# EasyEDA Pro project ProProject_Avaota Pi A_2024-03-25.epro, board 点位 (continued)
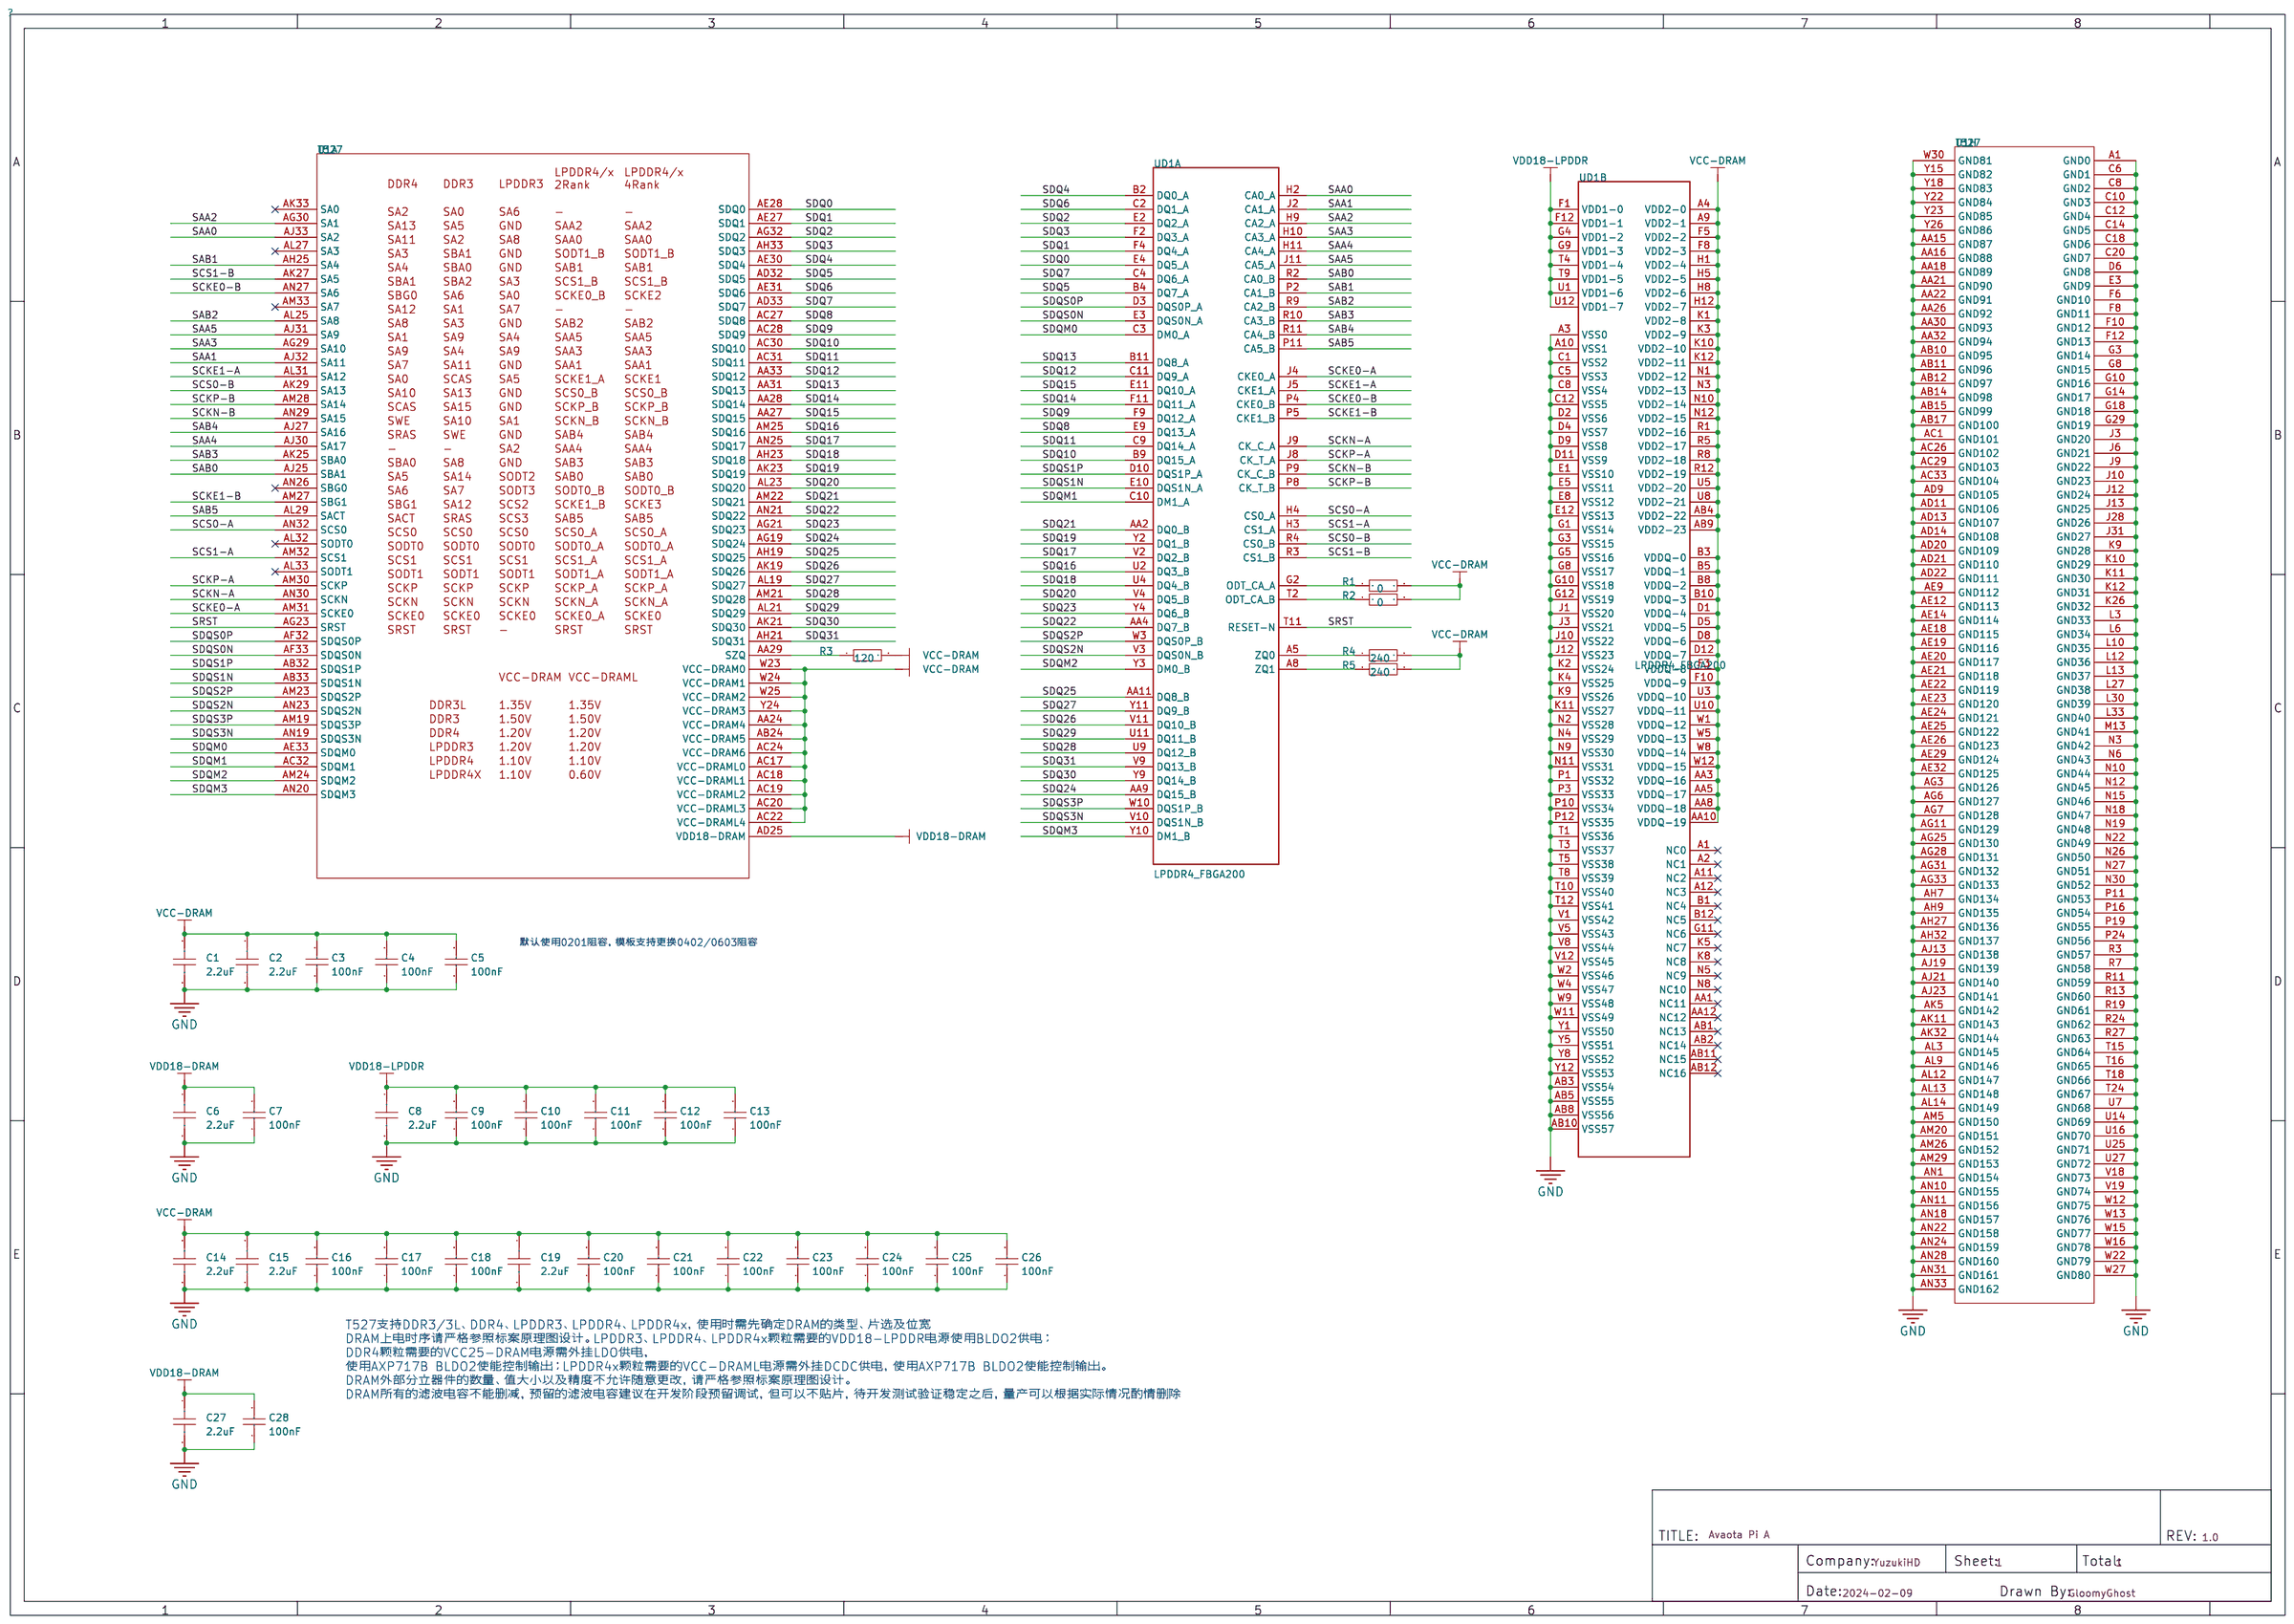
[diagram p0: schematic sheet]
## Routing (per net, layer and track width the routed paths; a pad name or vN(x,y) marks a point on that pad's centre or on a via; arc(x,y) is an arc through that point) (continued)
  Top Layer w0.115: 53.43,45.64 53.38,45.59 ; 53.38,45.59 53.39,45.59 U14.AN22 ; 53.38,45.59 52.63,45.59 52.07,45.03 51.2,45.03 50.8,45.44 v2(50.8,45.47)
  Top Layer w0.127: U14.C31 U14.C30 ; v2(35.38,50.42) 35.41,50.38 36.18,50.38 v2(36.23,50.43) ; D15.8 D15.3 ; C266.2 v3(67.61,17.7) ; 53.01,43.39 53,43.38 52.24,43.38 v2(52.09,43.23) ; D10.8 D10.3 ; v1(34.44,36.65) 35.23,35.87 35.23,34.21 35.81,33.63 ; D8.3 D8.8 ; v2(40.21,49.61) 40.11,49.71 39.35,49.71 ; v2(49.6,46.65) 49.06,46.65 48.94,46.53 48.49,46.53 48.16,46.86 48.16,47.62 48.33,47.8 v2(48.36,47.8) ; 41.41,46.15 41.71,46.46 43.13,46.46 44.88,44.7 44.88,44.48 48.46,40.89 52.74,40.89 ; v2(34.59,49.71) 34.58,49.72 33.92,49.72 ; 64.85,57.33 v3(64.99,57.47) ; 51.22,24.8 R60.1 51.37,24.56 v3(51.46,24.56) ; U8.N5 U8.P6 36.06,33.39 35.81,33.63 ; 35.81,33.63 35.81,34.03 U8.P4 ; 34.41,44.51 33.81,44.51 ; v3(65.58,17.7) C267.2 ; v2(52.19,41.81) 52.26,41.81 52.27,41.81 52.98,41.81 ; v3(50.14,22.33) D12.3 50.14,23.88 ; 35.81,48.1 35.81,47.7 ; D11.8 D11.3 ; D13.8 D13.3 ; v3(83.79,17.68) C275.1 ; v3(85.78,17.68) C272.2
  Top Layer w0.152: U8.G5 40.07,34.29 40.82,34.29 41.1,34.01 41.29,34.01 U8.C4 ; 50.22,56.41 50.91,55.72 C101.1 ; U14.AN18 52.56,47.65 51.97,48.23 48.79,48.23 v2(48.36,47.8) ; C15.1 C16.1 v1(14.99,47) ; U14.Y22 U14.AA22 U14.AA21 ; U14.Y22 U14.Y23 ; U14.Y22 U14.W22 ; 60.43,41.64 59.96,41.64 v2(59.9,41.59) ; 76.25,7.14 v3(76.25,7.24) ; 76.25,7.14 R112.1 ; 76.25,7.14 76.25,7.12 R114.1 ; C69.2 17.7,41.15 v1(17.53,41.33) ; v2(49.6,46.65) 49.84,46.89 51.76,46.89 52.04,46.61 52.58,46.61 52.86,46.89 53.07,46.89 ; U14.AG28 56.87,42.22 ; 56.87,42.22 U14.AE29 v2(57.91,42.42) ; 56.87,42.22 v2(56.94,41.66) U14.AG31 ; R104.1 R100.1 ; U14.R13 62.83,49.76 63.56,49.76 U14.M13 ; C64.1 C66.1 ; C64.1 C12.2 C62.1 C60.1 C65.2 C63.2 C17.2 C61.2 C59.2 C54.2 C53.2 C55.2 C52.2 C51.2 v1(14.99,47.83) ; C64.1 14.01,55.07 C35.1 ; v2(37.59,45.97) 37.87,45.97 38.36,46.46 39.28,46.46 v2(39.44,46.3) 39.6,46.46 40.07,46.46 40.16,46.38 40.24,46.46 41.09,46.46 41.41,46.15 ; C95.1 6.82,47.37 v3(7.29,47.37) ; R62.1 48.56,25.91 48.92,26.26 v1(49.38,26.26) ; U13.41 84.76,22.3 86.92,24.46 86.92,25.2 88.06,26.34 88.06,26.87 87.82,27.11 C274.2 ; TFT1.8 90.1,44.31 90.4,44.6 90.4,45.8 v1(90.02,46.18) ; C259.1 80.49,22.39 80.25,22.15 79.96,22.15 79.1,23.01 78.33,23.01 ; v2(36.17,47.33) 35.81,47.7 ; 35.28,41.94 35.15,41.91 v2(34.52,41.94) ; U14.T15 U14.T16 ; U14.A33 69.61,40.15 v3(69.85,40.39) 69.59,40.65 U14.A32 ; C258.2 C256.2 84.24,27.13 R111.1 R113.1 ; C73.2 13.98,44.46 13.72,44.2 13.72,42.6 13.97,42.34 14.25,42.34 14.52,42.61 U5.9 ; 51.33,44.29 49.97,44.29 49.07,45.19 v2(49.07,45.47) ; U14.AA7 59.43,53.14 v1(58.98,53.14) ; v1(66.42,51.13) 66.42,51.11 66.88,50.65 U14.F12 ; v2(53.34,39.03) 53.35,39.03 53.35,39.07 54.14,39.85 54.51,39.85 ; U14.T18 U14.R19 ; 43.46,33.25 43.32,33.39 U8.A6 ; 8.47,47.41 v3(8.47,47.04) ; 8.47,47.41 8.46,47.42 ; 8.47,47.41 C43.2 ; U14.C20 U14.C21 U14.B21 69.64,46.15 69.82,46.33 70.59,46.33 ; 78.33,48.95 79.07,48.21 81.59,48.21 81.79,48.41 81.79,48.9 81.59,49.1 v1(80.85,49.1) ; 53.41,41.12 53.16,41.12
  Top Layer w0.203: 36.61,44.2 37.21,44.2 v2(37.74,44.73) ; 42.27,45.5 42.35,45.5 42.47,45.38 43.04,45.38 43.15,45.49 43.2,45.49 v2(43.2,45.5) ; C291.1 3.54,57.11 R13.1 ; v2(52.67,39.03) 52.69,39.05 52.69,39.23 53.42,39.96 53.42,40.12 53.43,40.13 53.43,40.14 ; 53.16,41.12 52.93,40.89 52.74,40.89 ; U5.9 v3(15.85,42.61) v3(16.25,43.01) ; 63.4,56.72 63.4,57.38 v3(63.55,57.53) ; U14.AB12 U14.AB11 U14.AB10 U14.Y10 ; 71.05,44.25 71.08,44.22 v1(72.31,44.22) ; 35.81,42.25 35.59,42.25 35.28,41.94 ; 68.42,46.16 68.44,46.14 68.44,45.63 ; v2(37.72,41.33) 37.51,41.53 36.68,41.53 36.61,41.6 ; v2(44.36,48.74) 44.13,48.97 42.43,48.97 42.21,48.75 ; U14.AD13 U14.AD14 U14.AE14 ; C45.1 v1(5.31,56.85) ; 53.43,42.64 52.93,42.64
  Top Layer w0.254: U14.J28 U14.J26 ; U14.L10 U14.K10 ; U14.K10 U14.J10 ; U14.K10 U14.K9 ; U14.K10 U14.K11 U14.K12 ; U14.J31 64.94,41.65 U14.L30 v3(63.95,41.65) U14.N30 ; 60.43,43.14 60.5,43.21 60.5,43.38 60.24,43.64 58.43,43.64 ; 41.41,46.15 41.52,46.03 41.7,46.03 v2(41.73,46) ; 56.12,43.14 55.93,43.14 ; 56.12,43.14 56.43,42.83 56.43,42.64 ; 56.12,43.14 56.59,43.61 v2(56.59,43.67) 56.59,44 U14.AG25 ; 56.43,40.14 55.93,40.64 ; v3(57.44,46.64) v3(57.44,46.15) ; v3(57.44,46.64) U14.AD20 ; v3(57.44,46.64) v3(57.44,47.15) v3(57.44,47.64) ; v3(57.44,46.15) U14.AD21 ; v3(57.44,46.15) v3(57.44,45.64) ; v1(57.45,52.65) 57.45,52.16 U14.AE9 ; 63.35,48.65 v1(62.94,48.65) U14.N15 ; 63.35,48.65 U14.M16 U14.L16 U14.K16 ; 63.35,48.65 63.44,48.56 U14.N18 U14.N19 ; v2(33.78,46.71) 33.78,45.92 v2(33.77,45.91) ; v2(33.78,46.71) 33.78,47.6 v2(33.83,47.65) 33.83,47.72 34.21,48.1 v2(33.87,48.44) 33.72,48.44 32.94,49.22 32.94,49.46 32.76,49.63 v2(32.76,49.71) 33.09,49.71 33.41,50.02 33.41,50.05 33.74,49.72 v2(33.74,49.71) ; v2(33.78,46.71) 33.6,46.53 32.99,46.53 32.5,46.04 C148.1 C149.1 ; U14.AB11 U14.AD11 57.94,51.65 U14.AE9 ; v3(70.24,47.41) 70.25,47.42 ; 54.73,38.56 53.52,38.56 53.34,38.74 53.34,39.02 v2(53.34,39.03) ; 54.73,38.56 55.8,38.56 ; 54.73,38.56 54.46,38.84 v2(54.46,39.01) ; R8.1 13.38,39.91 12.8,40.49 10.9,40.49 10.62,40.21 R7.2 ; v2(34.63,40.62) 34.96,40.3 35.01,40.3 ; 55.8,38.56 58.04,38.56 58.16,38.68 v2(58.16,38.96) 58.06,39.06 58.06,39.77 58.43,40.14 ; 55.8,38.56 56.07,38.82 v2(56.07,39) ; 35.81,52 35.87,52 v2(36.22,52.35) 36.52,52.65 36.61,52.65 ; 39.01,42.9 38.65,43.26 38.38,43.26 37.89,43.74 v2(37.82,43.74) ; 39.01,53.95 38.88,54.08 v2(37.36,54.08) ; 39.01,52.65 38.4,53.25 v2(38.4,53.26) ; v3(63.93,53.65) U14.L6 U14.J6 ; 39.01,41.6 38.73,41.33 v2(38.56,41.33) ; U14.N22 63.44,45.59 62.94,45.09 U14.P24 U14.R24 U14.T24 U14.U25 v1(60.99,44.15) 60.99,43.46 61.3,43.15 U14.U27 ; 35.81,48.1 35.81,48.19 35.25,48.75 35.01,48.75 35.01,48.86 34.59,49.28 v2(34.59,49.71) 34.6,49.72 34.67,49.72 v2(35.38,50.42) 35.43,50.47 ; U14.W13 U14.W12 60.44,50.9 59.94,51.4 U14.Y10 ; U14.J10 65.44,51.1 ; U14.J10 U14.G10 ; U14.J10 U14.J9 65.44,52.62 v1(65.43,52.63) ; 58.44,56.14 58.44,56.48 58.29,56.63 ; U14.K12 U14.L12 U14.L13 U14.M13 U14.N12 63.44,50.91 63.21,51.15 U14.P11 ; U14.K12 U14.J12 ; v2(55.5,44.7) 55.43,44.77 55.43,45.59 v2(55.5,45.66) 55.5,46.08 55.43,46.14 55.43,46.63 v2(55.49,46.69) 55.49,47.08 55.43,47.14 ; v2(38.45,44.32) 38.58,44.2 39.01,44.2 ; U14.AK5 v1(54.44,54.65) ; v1(54.44,54.65) U14.AM5 ; v1(54.44,54.65) U14.AL3 ; v3(66.94,46.13) U14.F22 U14.F24 ; U14.AE14 57.02,50.06 57.02,50.37 57.3,50.65 U14.AE12 56.94,51.15 U14.AG11 U14.AJ13 v3(55.44,49.68) ; v2(33.81,44.47) 33.77,44.47 ; 33.77,44.47 33.81,44.51 ; 33.77,44.47 33.5,44.2 33,44.2 v2(32.93,44.26) 32.86,44.34 32.23,44.34 ; v2(33.77,45.91) 33.77,45.87 33.41,45.5 ; v2(33.77,45.91) 33.78,45.91 33.79,45.92 33.83,45.92 34.05,46.15 34.21,46.15 ; U8.G5 39.26,33.48 39.08,33.48 39.01,33.55 ; U14.U7 v3(61.95,53.15) U14.R7 62.88,53.15 v3(62.94,53.09) ; X3.2 61.06,20.29 C265.2 ; U14.R19 U14.P19 U14.N19 ; 32.23,42.46 32.23,43.14 32.6,42.77 v2(32.81,42.77) 32.94,42.9 33.41,42.9 ; 33.92,49.72 33.74,49.72 ; U14.AA15 U14.Y15 U14.W15 ; U14.AA15 U14.AB15 U14.AB14 ; U14.AA15 U14.AA16 U14.AB17 ; 42.21,42.9 42.43,42.9 v2(42.58,43.05) ; v2(38.66,49.88) 38.84,49.88 39.01,50.05 39.35,49.71 ; v1(65.91,52.63) 66.43,52.63 U14.G8 U14.F8 ; U14.AE9 U14.AD9 ; U14.R27 U14.N27 ; U14.N27 U14.L27 64.79,43.15 64.97,43.33 64.97,43.61 U14.K26 U14.K25 ; U14.N27 U14.N26 ; 65.44,51.1 66.39,51.1 v1(66.42,51.13) 66.44,51.15 U14.G10 ; 65.44,51.1 U14.J12 ; U14.N19 U14.M19 ; v2(59.9,41.59) 59.49,41.59 59.43,41.64 ; U14.K25 U14.K24 U14.H24 ; U14.K25 U14.L24 ; U14.J23 U14.J22 U14.K22 U14.K21 U14.J21 ; v2(32.74,51.62) 33.01,51.35 33.41,51.35 ; 39.81,46.15 39.65,46.3 v2(39.44,46.3) ; U14.J12 U14.J13 ; 34.41,44.51 34.56,44.51 v2(34.59,44.48) 34.73,44.48 35.01,44.2 35.05,44.2 v2(35.33,43.92) ; v3(53.11,56.34) 53.25,56.34 U14.AN1 ; 42.21,50.05 42.6,50.05 v2(42.8,50.24) ; v2(43.05,41.93) 43.05,41.91 42.74,41.6 42.21,41.6 41.82,41.98 v2(41.82,41.98) 41.81,41.99 41.81,41.99 41.56,42.25 41.41,42.25 ; v2(37.16,42.87) 37.13,42.9 36.61,42.9 ; v1(55.94,52.15) 55.94,52.62 55.93,52.63 55.94,52.64 U14.AH7 U14.AG7 U14.AG6 ; 52.93,42.64 52.89,42.6 52.89,42.6 52.82,42.53 v2(52.79,42.53) ; v2(40.84,54.56) 40.61,54.32 40.61,53.95 ; U14.G10 U14.F10 66.94,52.11 v1(66.93,52.12) 66.93,52.63 U14.F8 ; 58.43,42.14 58.19,42.14 v2(57.91,42.42) ; 39.01,33.55 39.01,33.49 v1(38.73,33.22) 38.73,32.95 U8.K8 38.17,32.38 37.79,32 37.79,31.19 38.02,30.96 38.74,30.96 U8.H10 U8.E7 ; 39.01,33.55 38.67,33.89 ; v3(70.16,43.18) 70.11,43.23 69.92,43.23 ; U14.P11 U14.R11 ; U14.P11 U14.N10 ; U14.D6 U14.C6 68.44,54.14 v3(68.45,54.15) ; R100.1 86.53,27.1 86.53,27.64 ; 40.61,40.3 40.49,40.18 40.49,39.89 v2(40.44,39.85) ; 60.94,48.15 U14.W16 ; 60.94,48.15 U14.V18 U14.V19 ; 60.94,48.14 v1(61.44,48.65) ; 39.01,51.35 39.01,51.26 38.75,51 38.49,51 38.22,50.74 v2(38.22,50.72) ; U14.T16 v1(61.44,48.65) ; v1(61.44,48.65) 61.44,49.52 C208.1 ; 35.81,46.15 35.53,45.87 35.38,45.87 v2(35.35,45.85) 35.01,45.5 ; 32.23,40.09 32.23,40.65 ; v2(40.18,41.33) 40.18,41.87 39.81,42.25 ; U14.F8 66.95,52.66 v3(66.95,53.14) 66.95,53.63 U14.F6 ; v2(32.76,48.67) 32.5,48.4 C158.1 ; 36.61,53.95 36.61,54.32 36.55,54.38 v2(36.47,54.38) ; 41.41,48.1 41.49,48.1 v2(41.68,48.29) ; 40.61,44.2 40.53,44.2 40.23,44.5 v2(40.23,44.53) ; 42.21,44.2 42.49,44.2 v2(42.85,43.84) ; v3(57.44,45.64) U14.AD22 ; v3(57.44,45.64) v3(57.44,45.15) v3(57.44,44.65) v3(57.44,44.15) U14.AE26 ; U14.N6 63.93,53.65 ; 40.6,48.75 40.18,49.17 40.18,49.58 v2(40.21,49.61) 40.21,49.61 40.21,49.65 40.61,50.05 40.2,50.45 40.2,50.95 v2(40.21,50.95) 40.18,50.98 40.18,51.62 39.81,52 ; v3(55.88,22.38) 55.88,22.98 D10.8 ; U14.M19 U14.M18 ; U14.M19 U14.L19 ; v1(42.01,19.61) 41.71,19.91 D8.3 ; v2(32.99,41.27) 33.08,41.27 33.65,41.84 33.74,41.84 v2(33.78,41.88) 33.84,41.88 34.21,42.25 ; U14.K15 U14.K16 ; U14.K16 U14.J17 65.94,48.15 U14.G18 ; 36.61,51.35 36.97,51.35 37.01,51.31 37.06,51.31 37.06,51.3 v2(37.09,51.3) ; v2(42.72,51.32) 42.71,51.32 42.7,51.33 42.59,51.33 42.57,51.35 42.21,51.35 ; 10.62,39.98 C10.2 ; C253.2 61.59,25.71 61.39,25.71 61.14,25.96 61.14,27.29 61.33,27.48 C254.2 62.08,27.94 64.92,27.94 65.18,27.69 65.18,27.33 C250.2 C249.2 66.71,27.28 66.75,27.24 ; v2(42.65,52.43) 42.44,52.65 42.1,52.65 41.85,52.4 v2(41.78,52.4) 41.78,52.37 41.41,52 ; 56.92,55.15 U14.AG3 ; U14.A1 69.67,56.38 v3(69.67,56.41) ; 67.96,27.24 68.55,27.24 ; U4.8 9.26,48.49 v3(9.44,48.32) ; 69.82,51.58 v3(70.35,51.58) ; U14.AL9 54.44,51.67 v1(54.43,51.66) 54.94,51.15 U14.AK11 U14.AL12 U14.AL13 v3(54.44,49.65) ; 34.21,52 34.12,52 v2(33.81,52.3) 33.75,52.3 33.41,52.65 ; v2(52.91,44.78) 53.02,44.66 53.41,44.66 53.43,44.64 ; U14.G28 U14.G29 66.92,42.15 v3(66.93,42.14) 67.44,42.14 U14.E29 ; v2(40.21,45.85) 40.55,45.5 40.61,45.5 ; 36.61,50.05 v2(36.23,50.43) ; 35.01,53.95 35.25,54.2 v2(35.25,54.41)
  Top Layer w0.508: 18.21,31.11 18.11,31.21 16.68,31.21 C8.1 ; USB3.A1B12 89.05,68.55 USB3.12 ; USB3.13 81.51,69.46 USB3.B1A12
  GND1 w0.076: 34.82,50.65 34.77,50.6 34.47,50.6 34.41,50.65 ; 35.18,42.21 35.22,42.21 35.25,42.24 35.51,42.24 35.53,42.21 35.63,42.21
  内层2 w0.152: v1(53.01,26.29) 58.45,31.72 67.26,31.72 68,32.46 68,33.96 71.52,37.48 74.99,37.48 75.22,37.25 v1(75.26,37.29) ; v1(74.83,36.17) 74.37,36.63 71.73,36.63 68.83,33.73 68.83,32.06 67.67,30.89 58.79,30.89 54.44,26.54 v1(54.44,26.26) ; v1(73,30.89) 73,30.61 72.36,29.97 59.36,29.97 55.98,26.59 55.98,26.3 55.94,26.26 v1(55.88,26.26)
  内层4 w0.152: v3(75.69,42.16) 75.72,42.14 76.58,42.14 78.03,40.69 78.03,29.97 75.87,27.81 71.2,27.81 69.34,29.67 60.5,29.67 59.03,28.19 48.41,28.19 46.96,26.75 46.96,23.88 45.97,22.89 v1(45.97,21.9) ; v3(75.82,41.1) 76.1,41.1 77.22,39.98 77.22,30.56 75.34,28.68 71.6,28.68 69.75,30.53 59.84,30.53 58.34,29.03 48.08,29.03 46.08,27.03 46.08,24.33 44.58,22.83 v3(44.58,21.79) ; v3(47.45,21.79) 47.45,22.53 47.83,22.91 47.83,26.37 48.87,27.41 59.46,27.41 60.73,28.68 69.24,28.68 70.89,27.03 76.28,27.03 78.87,29.62 78.87,41.2 76.94,43.13 v3(75.87,43.13)
  Bottom Layer w0.102: C30.2 C46.2
  Bottom Layer w0.152: v3(61.95,53.15) 62.06,53.15 62.33,53.42 62.33,55.73 62.08,55.98 C107.1 ; 27.36,19.53 27.25,19.43 27.25,17.55 v1(27.43,17.37) ; C213.1 C211.1 65.12,51.71 C75.2 C76.2 C78.2 C77.2 ; C226.1 41.85,32.42 C225.2 ; C277.1 89.41,48.46 88.9,48.97 88.11,48.97 87.77,48.63 87.77,47.76 ; 63.38,47.55 C49.2 C50.2 62.43,47.52 C24.2 C19.2 61.44,47.6 v1(61.44,48.65) 61.85,49.05 C47.2 61.85,49.11 C208.1 ; 63.38,47.55 63.41,47.58 C174.1 ; 63.38,47.55 C187.1 ; v3(53.11,56.34) 52.55,56.34 51.25,57.64 C183.1 51.25,58.87 C184.1 ; v1(58.98,53.14) 59.13,52.98 60.07,52.98 60.26,52.79 C112.1 ; R46.1 R44.1 66.94,45.71 v3(66.94,46.13) ; R55.1 R59.1
  Bottom Layer w0.203: C46.2 10.16,50.06 v1(9.75,50.06) ; 90.5,18.8 89.38,17.68 v3(85.78,17.68) v3(83.79,17.68) ; v2(33.83,47.65) 34.1,47.92 34.1,48.21 v2(33.87,48.44) ; 75.2,9.49 75.77,8.92 75.77,7.9 76.25,7.42 v3(76.25,7.24) ; 40.32,47.9 40.32,48.34 v2(40.23,48.43)
  Bottom Layer w0.254: 40.03,50.32 40.03,50.78 v2(40.21,50.95) ; v2(34.52,41.94) 34.64,41.81 35.33,41.81 35.58,42.06 36.1,42.06 ; C186.1 C185.1 64.94,45.54 ; C13.2 56.76,50.27 C14.2 56.81,50.23 C90.1 C93.1 57.88,49.2 C177.1 58.3,49.21 58.62,48.89 C84.2 C83.2 C86.2 61.2,48.89 v1(61.44,48.65) ; v2(35.25,54.41) 35.11,54.27 34.75,54.27 ; 51.61,43.79 51.66,43.79 51.81,43.63 ; v2(35.35,45.85) 35.61,45.85 36.02,46.26 36.07,46.26 ; C133.1 57.91,43.06 57.91,42.74 ; 38.21,43.26 37.82,43.65 v2(37.82,43.74) ; v2(42.72,51.32) 42.57,51.47 42.57,51.84 ; 40.37,41.91 40.37,41.52 v2(40.18,41.33) ; C172.1 56.48,55.03 56.59,55.14 v1(56.92,55.14) ; C58.2 C57.2 C67.2 ; 58.32,52.65 v1(57.45,52.65) 57.54,52.57 C102.1 ; 58.32,52.65 57.94,53.04 57.94,53.48 C103.1 ; 58.32,52.65 C113.1 ; 57.91,42.74 57.97,42.8 58.34,42.8 58.42,42.87 58.42,43.65 58.95,43.65 ; 57.91,42.74 v2(57.91,42.42) ; 51.81,43.63 51.81,43.84 52.55,43.84 52.58,43.87 ; 51.81,43.63 51.81,43.51 v2(52.09,43.23) ; C188.1 65.18,51.13 C216.1 C215.1 ; v1(75.69,34.34) 76.89,33.15 76.89,31.32 75.49,29.92 48.18,29.92 44.55,26.29 35.79,26.29 28.7,19.2 28.7,18.9 ; 39.52,54.28 40.56,54.28 v2(40.84,54.56) ; FPC2.23 93.74,39.46 93.52,39.68 84.48,39.68 83.62,40.54 83.62,49.48 v1(80.52,52.58) 79.63,53.47 v1(73.53,53.47) ; FPC2.25 85.55,40.46 84.51,41.5 84.51,49.63 79.93,54.2 75.26,54.2 74.52,54.94 v1(74.52,55.12) ; C106.1 60.03,55.99 59.72,55.68 59.72,55.02 R28.1 ; v1(80.85,49.1) 80.85,49.02 80.62,48.79 80.62,46.08 v1(81.1,45.59) 81.1,39.24 82.78,37.57 82.78,34.06 84.88,31.96 FPC2.8 ; 60.99,44.56 61.95,44.56 C22.2 C21.2 ; 60.99,44.56 v1(60.99,44.15) ; 60.99,44.56 60.99,45.03 C20.2 ; v1(30.18,18.9) 36.63,25.35 45.09,25.35 48.74,29.01 76.1,29.01 78.89,31.8 78.89,36.55 76.33,39.12 74.7,39.12 73.18,40.64 73.18,43.36 v1(72.31,44.22) ; v3(97.71,60.22) 98.5,61.01 SIM1.6 ; C41.2 59.44,46.51 v1(59.44,45.14) ; 43.2,43.2 42.73,43.2 v2(42.58,43.05) ; v3(61.06,18.24) 61.59,17.7 v3(65.58,17.7) v3(67.61,17.7) ; C230.1 38.82,33.13 v1(38.73,33.22) ; 33.29,40.66 33.29,40.97 v2(32.99,41.27) ; 35.42,44.4 35.42,44.01 v2(35.33,43.92) ; C174.1 63.41,48.65 v1(62.94,48.65) 63.41,49.11 C173.1 ; v2(36.23,50.43) 36.09,50.57 36.09,50.99 ; C40.2 60.86,48.31 C39.2 ; 59.94,43.65 60.28,43.65 60.5,43.43 60.5,43.21 v2(60.45,43.15) ; C176.1 65.44,45.54 64.94,45.54 ; 64.94,45.54 64.99,45.49 C201.1 ; 64.94,45.54 C175.1 ; v1(72.54,52.48) 79.22,52.48 v1(80.62,51.08) 82.58,49.12 v1(82.58,45.59) 82.55,45.57 82.55,39.6 83.9,38.25 83.9,35.05 85.49,33.46 FPC2.11 ; 40.51,39.27 40.54,39.3 40.54,39.75 v2(40.44,39.85) ; C26.2 C32.2 C34.2 4,54.81 C42.2 ; 27.36,19.53 35.28,27.46 44.27,27.46 47.5,30.68 66.88,30.68 71.22,35.03 v3(72.11,35.03) ; 37.99,44.22 38.35,44.22 v2(38.45,44.32) ; C181.1 C182.1 54.31,54.78 v1(54.44,54.65) 55.17,54.65 C202.1 ; C215.1 C68.2 ; C215.1 C104.1 ; 39.88,45.46 39.88,45.52 v2(40.21,45.85) ; v2(38.66,49.88) 38.66,49.78 38.22,49.34 ; C94.1 v1(54.43,51.66) ; C227.1 C163.1 C164.1 62.55,43.66 C91.1 62.68,43.76 63.04,43.76 63.22,43.57 63.32,43.57 ; C117.2 v2(34.59,44.48) ; 42.38,43.87 42.4,43.84 v2(42.85,43.84) 43.23,44.22 43.33,44.22
  Bottom Layer w0.508: 96.44,25.28 96.44,23.84 96.29,23.69
  Bottom Layer w0.762: RJ1.P10 72.79,11.9 RJ1.SHIELD0 ; RJ1.SHIELD0 RJ1.SHIELD1 ; RJ1.SHIELD0 75.2,9.49 RJ2.SHIELD1 RJ2.SHIELD0 91.06,11.88 RJ2.P10
  vias: v1(0.84,42.34) v1(1.99,68.89) v1(1.99,66.85) v1(1.99,20.12) v1(1.99,5.89) v1(4.02,68.89) v1(4.02,9.96) v1(4.02,5.89) v1(6.05,72.95) v1(6.05,66.85) v1(6.05,64.82) v1(6.05,62.79) v1(6.05,11.99) v1(6.05,9.96) v1(6.05,5.89) v1(6.05,3.86) v1(6.05,1.83) v1(6.6,65.96) v1(6.6,65.18) v1(6.66,64.47) v1(6.66,63.88) v1(6.76,66.5) v1(6.68,63.04) v1(6.68,62.26) v1(7.04,61.75) v1(7.24,66.68) v1(7.49,52.96) v1(7.49,52.25) v1(7.49,51.46) v1(7.49,50.7) v1(7.9,61.62) v1(8.13,66.75) v1(8.08,64.82) v1(8.08,7.93) v1(8.31,52.96) v1(8.31,52.25) v1(8.31,51.46) v1(8.31,50.7) v1(8.81,61.62) v1(8.94,66.8) v1(9.12,52.96) v1(9.12,52.25) v1(9.12,51.46) v1(9.47,38.53) v1(9.78,61.7) v1(9.93,66.5) v1(9.93,52.96) v1(9.93,52.25) v1(9.93,51.46) v1(10.11,66.85) v1(10.16,65.58) v1(10.11,62.79) v1(10.11,40.44) v1(10.11,11.99) v1(10.11,9.96) v1(10.11,7.93) v1(10.11,5.89) v1(10.11,3.86) v1(10.11,1.83) v1(10.46,62.15) v1(10.67,66.27) v1(10.59,63.32) v1(10.77,65.51) v1(10.97,62.66) v1(11.13,63.6) v1(11.46,65.48) v1(11.51,63.02) v1(11.61,66.17) v1(11.61,64.77) v1(11.91,63.63) v1(12.15,66.85) v1(12.12,65.51) v1(12.14,64.74) v1(12.17,63.02) v1(12.15,40.44) v1(12.15,11.99) v1(12.15,9.96) v1(12.15,7.93) v1(12.15,5.89) v1(12.15,3.86) v1(12.15,1.83) v1(12.5,63.65) v1(12.85,65.43) v1(12.93,62.99) v1(13.16,64.77) v1(13.33,63.7) v1(13.51,65.46) v1(13.59,63.02) v1(13.94,64.74) v1(14,63.73) v1(14.18,7.93) v1(14.18,5.89) v1(14.18,1.83) v1(14.27,65.46) v1(14.43,63.02) v1(14.55,64.77) v1(14.6,63.7) v1(16.21,36.37) v1(16.21,7.93) v1(16.21,5.89) v1(16.21,3.86) v1(16.21,1.83) v1(18.24,58.73) v1(18.24,36.37) v1(18.24,11.99) v1(18.24,7.93) v1(18.24,5.89) v1(20.27,64.82) v1(20.27,50.6) v1(20.27,48.57) v1(20.27,38.41) v1(20.27,11.99) v1(20.27,9.96) v1(20.27,7.93) v1(20.27,5.89) v1(20.27,3.86) v1(20.27,1.83) v1(20.96,59.26) v1(22.22,59.26) v1(22.31,64.82) v1(22.31,60.76) v1(22.31,58.73) v1(22.31,50.6) v1(22.31,38.41) v1(22.31,36.37) v1(22.31,20.12) v1(22.31,7.93) v1(22.31,1.83) v1(24.34,64.82) v1(24.34,60.76) v1(24.34,58.73) v1(24.34,46.53) v1(24.34,44.5) v1(24.34,42.47) v1(24.34,40.44) v1(24.34,38.41) v1(24.34,36.37) v1(24.34,20.12) v1(24.34,9.96) v1(24.34,7.93) v1(24.34,3.86) v1(24.34,1.83) v1(26.37,60.76) v1(26.37,48.57) v1(26.37,46.53) v1(26.37,44.5) v1(26.37,42.47) v1(26.37,40.44) v1(26.37,38.41) v1(26.37,36.37) v1(26.37,14.02) v1(26.37,1.83) v1(28.4,68.89) v1(28.4,64.82) v1(28.4,50.6) v1(28.4,48.57) v1(28.4,46.53) v1(28.4,44.5) v1(28.4,42.47) v1(28.4,40.44) v1(28.4,38.41) v1(28.4,36.37) v1(28.4,5.89) v1(28.4,3.86) v1(28.7,18.81) v1(30.43,68.89) v1(30.43,64.82) v1(30.43,58.73) v1(30.43,52.63) v1(30.43,50.6) v1(30.43,48.57) v1(30.43,46.53) v1(30.43,44.5) v1(30.43,42.47) v1(30.43,40.44) v1(30.43,38.41) v1(30.43,14.02) v1(30.43,3.86) v1(32.47,64.82) v1(32.47,38.41) v1(32.47,18.09) v1(32.47,3.86) v1(34.5,68.89) v1(34.5,64.82) v1(34.5,20.12) v1(34.5,18.09) v1(34.5,14.02) v1(36.53,68.89) v1(36.53,64.82) v1(36.53,22.15) v1(36.53,20.12) v1(38.56,68.89) v1(38.56,64.82) v1(38.56,36.37) v1(38.56,18.09) v1(38.56,16.05) v1(38.56,1.83) v1(40.59,68.89) v1(40.59,64.82) v1(40.59,24.18) v1(40.59,11.99) v1(40.59,9.96) v1(40.59,7.93) v1(40.59,1.83) v1(42.63,5.89) v1(42.63,3.86) v1(42.63,1.83) v1(44.66,68.89) v1(44.66,7.93) v1(44.66,1.83) v1(46.69,9.96) v1(46.69,3.86) v1(46.69,1.83) v1(48.72,18.09) v1(48.72,16.05) v1(48.72,14.02) v1(48.72,11.99) v1(48.72,9.96) v1(48.72,7.93) v1(48.72,5.89) v1(48.72,3.86) v1(48.72,1.83) v1(50.75,68.89) v1(50.75,9.96) v1(50.75,7.93) v1(50.75,3.86) v1(50.75,1.83) v1(52.79,68.89) v1(52.79,5.89) v1(52.79,3.86) v1(52.79,1.83) v1(54.82,68.89) v1(54.82,16.05) v1(54.82,14.02) v1(54.82,7.93) v1(54.82,3.86) v1(54.82,1.83) v1(56.85,3.86) v1(56.85,1.83) v1(57.78,26.26) v1(58.88,22.15) v1(58.88,18.09) v1(62.2,20.54) v1(64.98,72.95) v1(64.98,70.92) v1(65.38,23.56) v1(65.38,22.85) v1(65.38,22.06) v1(65.38,21.3) v1(66.19,23.56) v1(66.19,22.85) v1(66.19,22.06) v1(66.19,21.3) v1(67.01,66.85) v1(67.01,23.56) v1(67.01,22.85) v1(67.01,22.06) v1(67.01,21.3) v1(67.82,23.56) v1(67.82,22.85) v1(67.82,22.06) v1(67.82,21.3) v1(69.04,36.37) v1(71.07,72.95) v1(71.07,66.85) v1(71.25,34.65) v1(72.87,34.21) v1(73.11,72.95) v1(73.11,68.89) v1(73.11,66.85) v1(73.11,56.69) v1(73.11,18.09) v1(73.63,33.12) v1(73.63,31.72) v1(75.14,66.85) v1(75.14,58.73) v1(75.14,56.69) v1(75.14,20.12) v1(75.14,18.09) v1(77.17,66.85) v1(77.17,56.69) v1(77.17,20.12) v1(77.17,18.09) v1(79.2,72.95) v1(79.2,70.92) v1(79.2,68.89) v1(79.2,66.85) v1(79.2,56.69) v1(79.2,18.09) v1(79.3,49.78) v1(80.75,20.38) v1(81.23,70.92) v1(81.23,44.5) v1(81.23,42.47) v1(81.23,40.44) v1(81.23,36.37) v1(81.23,34.34) v1(81.23,32.31) v1(81.23,30.28) v1(83.27,72.95) v1(83.27,70.92) v1(83.27,30.28) v1(83.54,23.29) v1(83.54,22.58) v1(83.54,21.79) v1(83.54,21.03) v1(84.35,23.29) v1(84.35,22.58) v1(84.35,21.79) v1(84.35,21.03) v1(85.16,23.29) v1(85.16,22.58) v1(85.16,21.79) v1(85.16,21.03) v1(85.3,72.95) v1(85.3,70.92) v1(85.98,23.29) v1(85.98,22.58) v1(85.98,21.79) v1(85.98,21.03) v1(87.33,72.95) v1(87.33,70.92) v1(87.33,60.76) v1(89.36,70.92) v1(89.36,60.76) v1(89.36,58.73) v1(90.68,36.47) v1(91.39,72.95) v1(91.39,70.92) v1(91.39,22.15) v1(91.39,18.09) v1(93.43,72.95) v1(93.43,70.92) v1(93.43,68.89) v1(93.43,62.79) v1(93.43,46.53) v1(93.43,28.25) v1(93.43,22.15) v1(93.43,20.12) v1(93.43,18.09) v1(95.46,68.89) v1(95.46,60.76) v1(95.46,58.73) v1(95.46,40.44) v1(95.46,36.37) v1(95.46,30.28) v1(95.46,20.12) v1(95.46,5.89) v1(97.49,68.89) v1(97.49,14.02) v1(97.49,11.99) v1(97.49,7.93) v2(51.74,47.73) v3(15.85,43.49) v3(16.71,43.49) v3(16.71,42.61) v3(58.23,56.63) v3(70.18,45.3) v3(75.64,4.19) v3(76.33,1.14) v3(76.89,4.19) v3(85.47,54.43) v3(85.47,53.85) v3(85.83,57) v3(85.83,56.41)
VBUS: length 310
  Top Layer w0.127: 41.76,23.62 41.48,23.34 R52.1 ; 41.76,23.62 39.73,23.62 v3(39.57,23.47) ; 41.76,23.62 42.27,23.62 42.54,23.34 R53.1
  Top Layer w0.152: C222.2 39.5,24.18
  Top Layer w0.203: D9.2 v3(39.57,22.25)
  Top Layer w0.254: LED5.4 2.3,8.19 1.7,8.79 1.7,10.22 LED4.4 2.42,11.14 1.68,11.89 1.68,13.15 LED3.4 2.34,14.09 1.85,14.58 v1(1.85,16.28) LED2.4
  Top Layer w0.508: D1.2 17.22,35.06 v1(17.22,36.58) ; v3(96.72,66.88) v3(96.27,66.88) C280.2 94.27,66.88 U17.5
  内层2 w0.508: v1(10.77,43.56) 10.77,43 15.6,38.18 15.62,38.18 v1(17.22,36.58)
  内层4 w0.508: v1(97.61,22.25) 97.61,22.78 95.86,24.54 80.87,24.54 78.66,22.33 74.88,22.33 73.13,24.08 68.91,24.08 68.05,24.94 61.95,24.94 60.83,23.83 59.41,23.83 57.38,21.79 51.33,21.79 50.14,20.6 42.01,20.6 v1(38.49,17.08) v1(38.16,16.75)
  Inner5 w0.508: v1(1.85,16.28) 3.81,18.24 3.81,19.1 ; H1.4 H1.2 6.22,71.55 6.22,69.93 ; v3(96.72,66.88) v3(96.27,66.88) 95.81,66.42 95.81,62.92 96.29,62.43 96.29,55.91 95.05,54.66 95.05,51.16 95.71,50.5 95.71,48.46 97.61,46.56 v1(97.61,22.25)
  Inner5 w1.27: 3.2,37.72 2.69,38.21 ; 3.2,37.72 3.2,20.17 4.14,19.23 4.14,16 6.5,13.64 17.48,13.64 18.59,14.76 22.1,14.76 ; 3.2,37.72 5.77,40.28 8.43,40.28 ; 8.43,40.28 7.39,39.24 v1(7.39,37.44) ; 8.43,40.28 10.79,42.65 10.77,42.67 v1(10.77,43.05) v1(10.77,43.56) ; 2.9,65.32 2.9,55.45 2.15,54.71 2.15,51.95 2.49,51.61 2.49,38.3 ; 2.9,65.32 6.22,68.65 6.22,69.93 ; 2.9,65.32 2.9,65.46 2.87,65.48 ; 36.47,15.04 35.79,15.72 22.71,15.72 21.89,14.91
  Bottom Layer w0.203: v3(39.57,22.25) v3(39.57,23.47)
  Bottom Layer w0.254: FPC1.2 7.23,37.28 v1(7.39,37.44) ; v1(7.39,37.44) C247.2 ; v1(7.39,37.44) 7.05,37.78 FPC1.1
  Bottom Layer w0.508: v3(39.57,22.25) 39.57,18.16 v1(38.49,17.08) ; 97.46,25.28 97.56,25.18 U11.3 97.61,23.64 v1(97.61,22.25) ; v1(36.24,14.83) 36.45,15.04 v1(36.65,15.24) v1(38.16,16.75) ; USB2.1 26.01,7.71 26.01,9.96 USB2.10 ; v1(10.77,43.56) v1(10.77,43.05)
  Bottom Layer w1.27: C294.2 38.15,13.34 38.15,3.45 36.6,1.91 28.93,1.91 25.53,5.3 USB2.1
  vias: v1(4.62,50.32) v1(35.89,15.52) v1(36.98,14.66) v3(4.12,50.29) v3(4.12,49.76) v3(4.12,49.23) v3(4.12,48.66) v3(5.13,50.37)
VBUS-USB: length 13.7
  Top Layer w0.152: R120.2 91.97,68.11 U17.1
  Top Layer w0.508: USB3.B4A9 83.2,69.43 83.52,69.75 84.61,69.75 84.89,70.03 85.98,70.03 86.33,69.67 87.71,69.67 88.1,69.28 USB3.A4B9 88.1,67.81 89.09,66.82 C282.2 C281.2 90.59,66.86 U17.1
VCC-3V3-BLK: length 2.1
  Bottom Layer w0.254: C277.2 88.77,46.33 R126.2 88.72,47.76 88.72,47.76
VCC-LDO-RTC: length 72.2
  Top Layer w0.152: R10.1 7.85,47.32 7.49,46.96 6.4,46.96 v3(6.27,47.09) R9.1
  Top Layer w0.203: C45.2 5.36,55.91 5.77,55.5 6.48,55.5 6.71,55.27 7.54,55.27 7.66,55.15 U4.35 ; U14.AE13 57.44,50.18 v1(57.94,50.67)
  内层2 w0.152: v1(6.4,50.24) 6.27,50.11 v3(6.27,47.09)
  Inner5 w0.381: v1(14.53,53.95) 14.22,53.95 13.59,54.58 12.55,54.58 12.42,54.71 6.55,54.71 v1(5.47,55.79)
  Bottom Layer w0.152: v1(5.47,55.79) 5.82,55.45 6.88,55.45 7.04,55.3 7.04,50.88 v1(6.4,50.24)
  Bottom Layer w0.203: v1(57.94,50.67) 57.37,51.24 51.55,51.24 47.29,55.5 16.08,55.5 v1(14.53,53.95)
